# EasyEDA Pro project C108_STM32.eprj, schematic Schematic3
Board Name: Board3; Create Date: 2024-12-05; Page Name: P1; Project Name: C108_STM32; Schematic Name: Schematic3; Update Date: 2024-12-06; Company: 嘉立创EDA; Page Size: A4; Version: V1.0
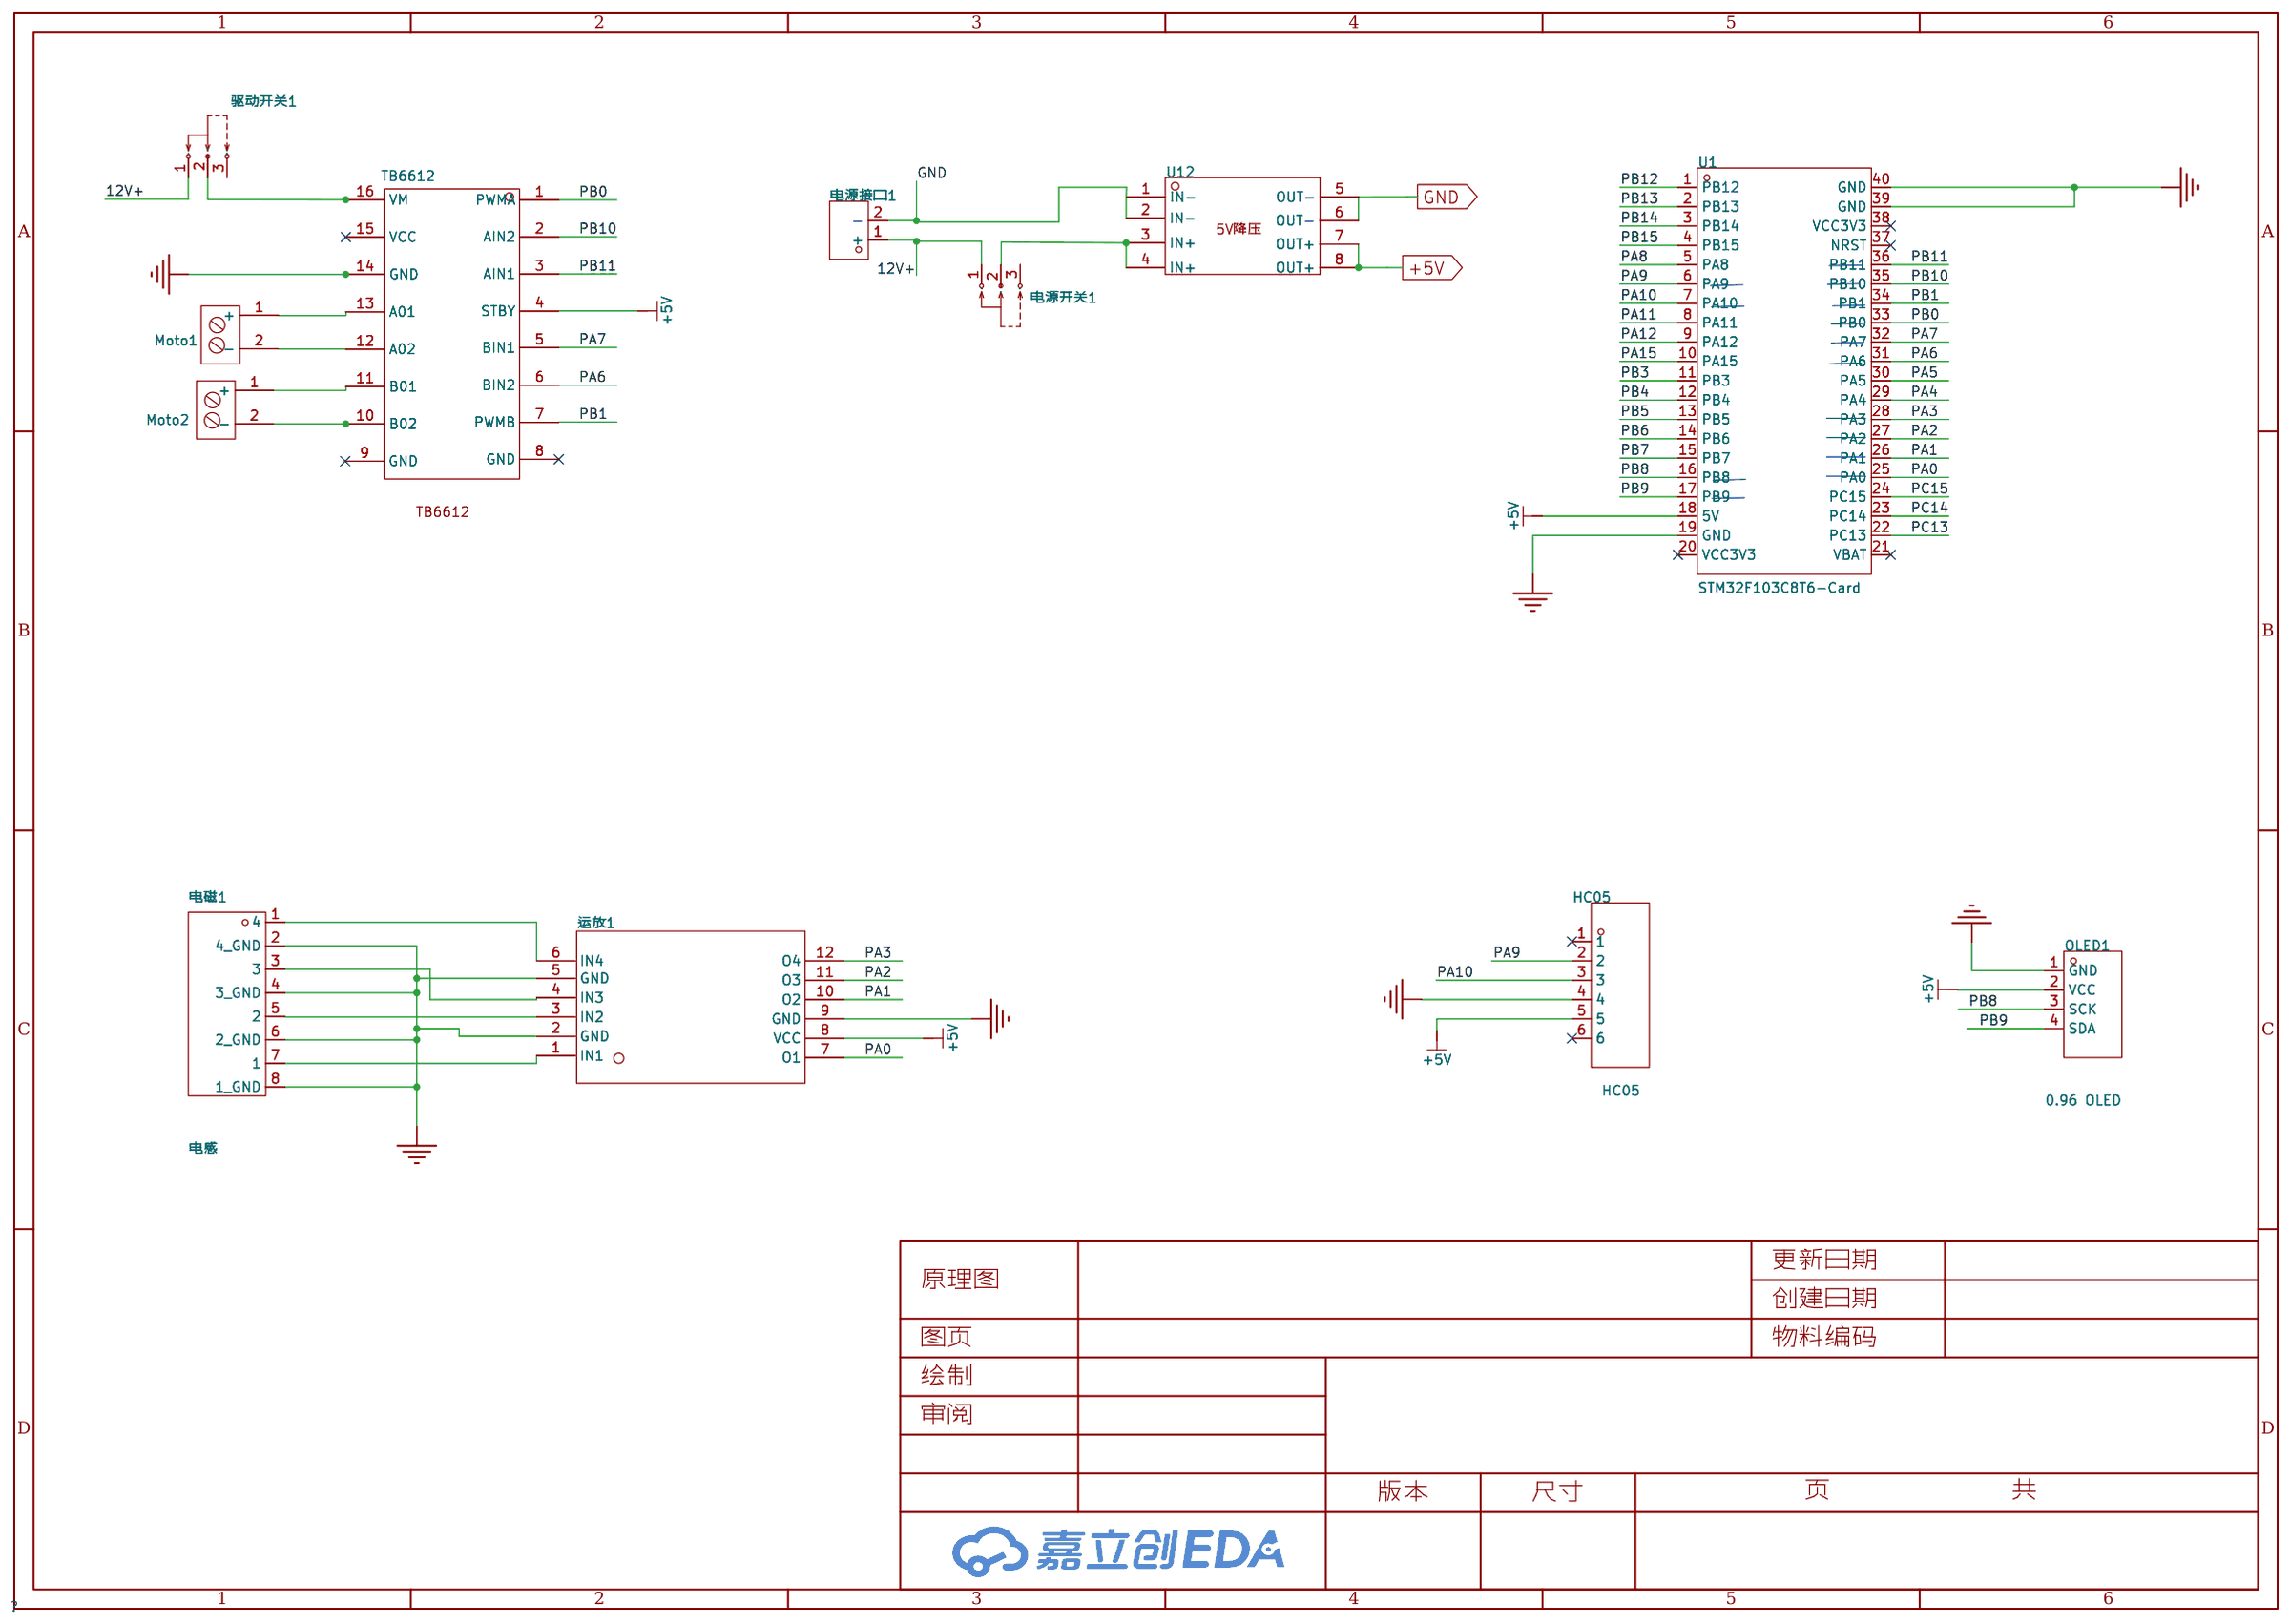
[diagram p2: schematic sheet]

## Parts
HC05  HC05  [HDR-TH_6P-P2.54-V-M]
Moto1  -  [端子]
Moto2  -  [端子]
OLED1  0.96 OLED  [HDR-TH_4P-P2.54-V-M-1]
TB6612  -  [TB6612_Board]
U1  STM32F103C8T6-Card  [CONN-TH_L53.3-W22.9_STM32F103C8T6-CARD]
U12  -  [降压mini]
电源开关1  电源开关  [SW-TH_SHOU-HAN_SS12D10G4]
电源接口1  XH2.54*2P_直插  [CONN-TH_2P-P2.50-XH2.54-2P]
电磁1  电感  [HDR-TH_8P-P2.54-V-M]
运放1  -  [逐飞运放]
驱动开关1  驱动开关  [SW-TH_SHOU-HAN_SS12D10G4]

## Library data of the parts
HC05 = 单排2.54*6: Supplier Part: C9900016160; Supplier Footprint: 2.54x2x6; JLCPCB Part Class: 扩展库; Supplier: LCSC
Moto1 Moto2 = 端子
OLED1 = 2.54*4单排: Supplier Part: C9900016163; Supplier Footprint: 2.54x4; JLCPCB Part Class: 扩展库; Supplier: LCSC
TB6612 = TB6612_Board
U1 = STM32F103C8T6-Card: Supplier Part: C9900077949; Supplier Footprint: 插件; Supplier: LCSC
U12 = 降压mini
电源开关1 驱动开关1 = SS12D10开关: LCSC Part Name: SS12D10/G5/直角; Supplier Part: C9900029541; Supplier Footprint: THrough hole; JLCPCB Part Class: 扩展库; Supplier: LCSC
电源接口1 = XH2.54*2P_直插: Supplier Part: C9900008615; Supplier Footprint: XH2.54_2P; Supplier: LCSC
电磁1 = 2.54*8单排: Supplier Part: C9900016164; Supplier Footprint: 2.54x8; JLCPCB Part Class: 扩展库; Supplier: LCSC
运放1 = 逐飞运放

## Nets
12V+: 电源开关1.1 电源接口1.1(+) 驱动开关1.1
+5V: HC05.5 OLED1.2(VCC) TB6612.4(STBY) U1.18(5V) U12.7(OUT+) U12.8(OUT+) 运放1.8(VCC)
GND: HC05.4 OLED1.1(GND) TB6612.14(GND) U1.19(GND) U1.39(GND) U1.40(GND) U12.2(IN-) U12.6(OUT-) 电源接口1.2(-) 电磁1.2(4_GND) 电磁1.4(3_GND) 电磁1.6(2_GND) 电磁1.8(1_GND) 运放1.2(GND) 运放1.5(GND) 运放1.9(GND)
PA0: U1.25(PA0) 运放1.7(O1)
PA1: U1.26(PA1) 运放1.10(O2)
PA2: U1.27(PA2) 运放1.11(O3)
PA3: U1.28(PA3) 运放1.12(O4)
PA4: U1.29(PA4)
PA5: U1.30(PA5)
PA6: TB6612.6(BIN2) U1.31(PA6)
PA7: TB6612.5(BIN1) U1.32(PA7)
PA8: U1.5(PA8)
PA9: HC05.2 U1.6(PA9)
PA10: HC05.3 U1.7(PA10)
PA11: U1.8(PA11)
PA12: U1.9(PA12)
PA15: U1.10(PA15)
PB0: TB6612.1(PWMA) U1.33(PB0)
PB1: TB6612.7(PWMB) U1.34(PB1)
PB3: U1.11(PB3)
PB4: U1.12(PB4)
PB5: U1.13(PB5)
PB6: U1.14(PB6)
PB7: U1.15(PB7)
PB8: OLED1.3(SCK) U1.16(PB8)
PB9: OLED1.4(SDA) U1.17(PB9)
PB10: TB6612.2(AIN2) U1.35(PB10)
PB11: TB6612.3(AIN1) U1.36(PB11)
PB12: U1.1(PB12)
PB13: U1.2(PB13)
PB14: U1.3(PB14)
PB15: U1.4(PB15)
PC13: U1.22(PC13)
PC14: U1.23(PC14)
PC15: U1.24(PC15)
$1N892: Moto1.1(+) TB6612.13(A01)
$1N894: Moto2.1(+) TB6612.11(B01)
$1N895: Moto2.2(-) TB6612.10(B02)
$1N906: 电磁1.7(1) 运放1.1(IN1)
$1N907: 电磁1.5(2) 运放1.3(IN2)
$1N908: 电磁1.3 运放1.4(IN3)
$1N909: 电磁1.1(4) 运放1.6(IN4)
$1N915: TB6612.16(VM) 驱动开关1.2
Net-(U12-3): U12.3(IN+) U12.4(IN+)

Not connected (* = marked no-connect by the designer): HC05 1* 6*; Moto1 2(-); TB6612 8(GND)* 9(GND)* 12(A02) 15(VCC)*; U1 20(VCC3V3)* 21(VBAT)* 37(NRST)* 38(VCC3V3)*; U12 1(IN-) 5(OUT-); 电源开关1 2 3; 驱动开关1 3
